# EAGLE schematic Resistor_Resistor (EAGLE 8.3.0), part 10 of 43
## Parts (continued)
R13078  10K  RESISTOR_0201  [0201]
R13079  10K  RESISTOR_0201  [0201]
R13080  10K  RESISTOR_0201  [0201]
R13081  10K  RESISTOR_0201  [0201]
R13082  10K  RESISTOR_0201  [0201]
R13083  10K  RESISTOR_0201  [0201]
R13084  10K  RESISTOR_0201  [0201]
R13085  10K  RESISTOR_0201  [0201]
R13086  10K  RESISTOR_0201  [0201]
R13087  10K  RESISTOR_0201  [0201]
R13088  10K  RESISTOR_0201  [0201]
R13089  10K  RESISTOR_0201  [0201]
R13090  10K  RESISTOR_0201  [0201]
R13091  10K  RESISTOR_0201  [0201]
R13092  10K  RESISTOR_0201  [0201]
R13093  10K  RESISTOR_0201  [0201]
R13094  10K  RESISTOR_0201  [0201]
R13095  10K  RESISTOR_0201  [0201]
R13096  10K  RESISTOR_0201  [0201]
R13097  10K  RESISTOR_0201  [0201]
R13098  10K  RESISTOR_0201  [0201]
R13099  10K  RESISTOR_0201  [0201]
R13100  10K  RESISTOR_0201  [0201]
R13101  10K  RESISTOR_0201  [0201]
R13102  10K  RESISTOR_0201  [0201]
R13103  10K  RESISTOR_0201  [0201]
R13104  10K  RESISTOR_0201  [0201]
R13105  10K  RESISTOR_0201  [0201]
R13106  10K  RESISTOR_0201  [0201]
R13107  10K  RESISTOR_0201  [0201]
R13108  10K  RESISTOR_0201  [0201]
R13109  10K  RESISTOR_0201  [0201]
R13110  10K  RESISTOR_0201  [0201]
R13111  10K  RESISTOR_0201  [0201]
R13112  10K  RESISTOR_0201  [0201]
R13113  10K  RESISTOR_0201  [0201]
R13114  10K  RESISTOR_0201  [0201]
R13115  10K  RESISTOR_0201  [0201]
R13116  10K  RESISTOR_0201  [0201]
R13117  10K  RESISTOR_0201  [0201]
R13118  10K  RESISTOR_0201  [0201]
R13119  10K  RESISTOR_0201  [0201]
R13120  10K  RESISTOR_0201  [0201]
R13121  10K  RESISTOR_0201  [0201]
R13122  10K  RESISTOR_0201  [0201]
R13123  10K  RESISTOR_0201  [0201]
R13124  10K  RESISTOR_0201  [0201]
R13125  10K  RESISTOR_0201  [0201]
R13126  10K  RESISTOR_0201  [0201]
R13127  10K  RESISTOR_0201  [0201]
R13128  10K  RESISTOR_0201  [0201]
R13129  10K  RESISTOR_0201  [0201]
R13130  10K  RESISTOR_0201  [0201]
R13131  10K  RESISTOR_0201  [0201]
R13132  10K  RESISTOR_0201  [0201]
R13133  10K  RESISTOR_0201  [0201]
R13134  10K  RESISTOR_0201  [0201]
R13135  10K  RESISTOR_0201  [0201]
R13136  10K  RESISTOR_0201  [0201]
R13137  10K  RESISTOR_0201  [0201]
R13138  10K  RESISTOR_0201  [0201]
R13139  10K  RESISTOR_0201  [0201]
R13140  10K  RESISTOR_0201  [0201]
R13141  10K  RESISTOR_0201  [0201]
R13142  10K  RESISTOR_0201  [0201]
R13143  10K  RESISTOR_0201  [0201]
R13144  10K  RESISTOR_0201  [0201]
R13145  10K  RESISTOR_0201  [0201]
R13146  10K  RESISTOR_0201  [0201]
R13147  10K  RESISTOR_0201  [0201]
R13148  10K  RESISTOR_0201  [0201]
R13149  10K  RESISTOR_0201  [0201]
R13150  10K  RESISTOR_0201  [0201]
R13151  10K  RESISTOR_0201  [0201]
R13152  10K  RESISTOR_0201  [0201]
R13153  10K  RESISTOR_0201  [0201]
R13154  10K  RESISTOR_0201  [0201]
R13155  10K  RESISTOR_0201  [0201]
R13156  10K  RESISTOR_0201  [0201]
R13157  10K  RESISTOR_0201  [0201]
R13158  10K  RESISTOR_0201  [0201]
R13159  10K  RESISTOR_0201  [0201]
R13160  10K  RESISTOR_0201  [0201]
R13161  10K  RESISTOR_0201  [0201]
R13162  10K  RESISTOR_0201  [0201]
R13163  10K  RESISTOR_0201  [0201]
R13164  10K  RESISTOR_0201  [0201]
R13165  10K  RESISTOR_0201  [0201]
R13166  10K  RESISTOR_0201  [0201]
R13167  10K  RESISTOR_0201  [0201]
R13168  10K  RESISTOR_0201  [0201]
R13169  10K  RESISTOR_0201  [0201]
R13170  10K  RESISTOR_0201  [0201]
R13171  10K  RESISTOR_0201  [0201]
R13172  10K  RESISTOR_0201  [0201]
R13173  10K  RESISTOR_0201  [0201]
R13174  10K  RESISTOR_0201  [0201]
R13175  10K  RESISTOR_0201  [0201]
R13176  10K  RESISTOR_0201  [0201]
R13177  10K  RESISTOR_0201  [0201]
R13178  10K  RESISTOR_0201  [0201]
R13179  10K  RESISTOR_0201  [0201]
R13180  10K  RESISTOR_0201  [0201]
R13181  10K  RESISTOR_0201  [0201]
R13182  10K  RESISTOR_0201  [0201]
R13183  10K  RESISTOR_0201  [0201]
R13184  10K  RESISTOR_0201  [0201]
R13185  10K  RESISTOR_0201  [0201]
R13186  10K  RESISTOR_0201  [0201]
R13187  10K  RESISTOR_0201  [0201]
R13188  10K  RESISTOR_0201  [0201]
R13189  10K  RESISTOR_0201  [0201]
R13190  10K  RESISTOR_0201  [0201]
R13191  10K  RESISTOR_0201  [0201]
R13192  10K  RESISTOR_0201  [0201]
R13193  10K  RESISTOR_0201  [0201]
R13194  10K  RESISTOR_0201  [0201]
R13195  10K  RESISTOR_0201  [0201]
R13196  10K  RESISTOR_0201  [0201]
R13197  10K  RESISTOR_0201  [0201]
R13198  10K  RESISTOR_0201  [0201]
R13199  10K  RESISTOR_0201  [0201]
R13200  10K  RESISTOR_0201  [0201]
R13201  10K  RESISTOR_0201  [0201]
R13202  10K  RESISTOR_0201  [0201]
R13203  10K  RESISTOR_0201  [0201]
R13204  10K  RESISTOR_0201  [0201]
R13205  10K  RESISTOR_0201  [0201]
R13206  10K  RESISTOR_0201  [0201]
R13207  10K  RESISTOR_0201  [0201]
R13208  10K  RESISTOR_0201  [0201]
R13209  10K  RESISTOR_0201  [0201]
R13210  10K  RESISTOR_0201  [0201]
R13211  10K  RESISTOR_0201  [0201]
R13212  10K  RESISTOR_0201  [0201]
R13213  10K  RESISTOR_0201  [0201]
R13214  10K  RESISTOR_0201  [0201]
R13215  10K  RESISTOR_0201  [0201]
R13216  10K  RESISTOR_0201  [0201]
R13217  10K  RESISTOR_0201  [0201]
R13218  10K  RESISTOR_0201  [0201]
R13219  10K  RESISTOR_0201  [0201]
R13220  10K  RESISTOR_0201  [0201]
R13221  10K  RESISTOR_0201  [0201]
R13222  10K  RESISTOR_0201  [0201]
R13223  10K  RESISTOR_0201  [0201]
R13224  10K  RESISTOR_0201  [0201]
R13225  10K  RESISTOR_0201  [0201]
R13226  10K  RESISTOR_0201  [0201]
R13227  10K  RESISTOR_0201  [0201]
R13228  10K  RESISTOR_0201  [0201]
R13229  10K  RESISTOR_0201  [0201]
R13230  10K  RESISTOR_0201  [0201]
R13231  10K  RESISTOR_0201  [0201]
R13232  10K  RESISTOR_0201  [0201]
R13233  10K  RESISTOR_0201  [0201]
R13234  10K  RESISTOR_0201  [0201]
R13235  10K  RESISTOR_0201  [0201]
R13236  10K  RESISTOR_0201  [0201]
R13237  10K  RESISTOR_0201  [0201]
R13238  10K  RESISTOR_0201  [0201]
R13239  10K  RESISTOR_0201  [0201]
R13240  10K  RESISTOR_0201  [0201]
R13241  10K  RESISTOR_0201  [0201]
R13242  10K  RESISTOR_0201  [0201]
R13243  10K  RESISTOR_0201  [0201]
R13244  10K  RESISTOR_0201  [0201]
R13245  10K  RESISTOR_0201  [0201]
R13246  10K  RESISTOR_0201  [0201]
R13247  10K  RESISTOR_0201  [0201]
R13248  10K  RESISTOR_0201  [0201]
R13249  10K  RESISTOR_0201  [0201]
R13250  10K  RESISTOR_0201  [0201]
R13251  10K  RESISTOR_0201  [0201]
R13252  10K  RESISTOR_0201  [0201]
R13253  10K  RESISTOR_0201  [0201]
R13254  10K  RESISTOR_0201  [0201]
R13255  10K  RESISTOR_0201  [0201]
R13256  10K  RESISTOR_0201  [0201]
R13257  10K  RESISTOR_0201  [0201]
R13258  10K  RESISTOR_0201  [0201]
R13259  10K  RESISTOR_0201  [0201]
R13260  10K  RESISTOR_0201  [0201]
R13261  10K  RESISTOR_0201  [0201]
R13262  10K  RESISTOR_0201  [0201]
R13263  10K  RESISTOR_0201  [0201]
R13264  10K  RESISTOR_0201  [0201]
R13265  10K  RESISTOR_0201  [0201]
R13266  10K  RESISTOR_0201  [0201]
R13267  10K  RESISTOR_0201  [0201]
R13268  10K  RESISTOR_0201  [0201]
R13269  10K  RESISTOR_0201  [0201]
R13270  10K  RESISTOR_0201  [0201]
R13271  10K  RESISTOR_0201  [0201]
R13272  10K  RESISTOR_0201  [0201]
R13273  10K  RESISTOR_0201  [0201]
R13274  10K  RESISTOR_0201  [0201]
R13275  10K  RESISTOR_0201  [0201]
R13276  10K  RESISTOR_0201  [0201]
R13277  10K  RESISTOR_0201  [0201]
R13278  10K  RESISTOR_0201  [0201]
R13279  10K  RESISTOR_0201  [0201]
R13280  10K  RESISTOR_0201  [0201]
R13281  10K  RESISTOR_0201  [0201]
R13282  10K  RESISTOR_0201  [0201]
R13283  10K  RESISTOR_0201  [0201]
R13284  10K  RESISTOR_0201  [0201]
R13285  10K  RESISTOR_0201  [0201]
R13286  10K  RESISTOR_0201  [0201]
R13287  10K  RESISTOR_0201  [0201]
R13288  10K  RESISTOR_0201  [0201]
R13289  10K  RESISTOR_0201  [0201]
R13290  10K  RESISTOR_0201  [0201]
R13291  10K  RESISTOR_0201  [0201]
R13292  10K  RESISTOR_0201  [0201]
R13293  10K  RESISTOR_0201  [0201]
R13294  10K  RESISTOR_0201  [0201]
R13295  10K  RESISTOR_0201  [0201]
R13296  10K  RESISTOR_0201  [0201]
R13297  10K  RESISTOR_0201  [0201]
R13298  10K  RESISTOR_0201  [0201]
R13299  10K  RESISTOR_0201  [0201]
R13300  10K  RESISTOR_0201  [0201]
R13301  10K  RESISTOR_0201  [0201]
R13302  10K  RESISTOR_0201  [0201]
R13303  10K  RESISTOR_0201  [0201]
R13304  10K  RESISTOR_0201  [0201]
R13305  10K  RESISTOR_0201  [0201]
R13306  10K  RESISTOR_0201  [0201]
R13307  10K  RESISTOR_0201  [0201]
R13308  10K  RESISTOR_0201  [0201]
R13309  10K  RESISTOR_0201  [0201]
R13310  10K  RESISTOR_0201  [0201]
R13311  10K  RESISTOR_0201  [0201]
R13312  10K  RESISTOR_0201  [0201]
R13313  10K  RESISTOR_0201  [0201]
R13314  10K  RESISTOR_0201  [0201]
R13315  10K  RESISTOR_0201  [0201]
R13316  10K  RESISTOR_0201  [0201]
R13317  10K  RESISTOR_0201  [0201]
R13318  10K  RESISTOR_0201  [0201]
R13319  10K  RESISTOR_0201  [0201]
R13320  10K  RESISTOR_0201  [0201]
R13321  10K  RESISTOR_0201  [0201]
R13322  10K  RESISTOR_0201  [0201]
R13323  10K  RESISTOR_0201  [0201]
R13324  10K  RESISTOR_0201  [0201]
R13325  10K  RESISTOR_0201  [0201]
R13326  10K  RESISTOR_0201  [0201]
R13327  10K  RESISTOR_0201  [0201]
R13328  10K  RESISTOR_0201  [0201]
R13329  10K  RESISTOR_0201  [0201]
R13330  10K  RESISTOR_0201  [0201]
R13331  10K  RESISTOR_0201  [0201]
R13332  10K  RESISTOR_0201  [0201]
R13333  10K  RESISTOR_0201  [0201]
R13334  10K  RESISTOR_0201  [0201]
R13335  10K  RESISTOR_0201  [0201]
R13336  10K  RESISTOR_0201  [0201]
R13337  10K  RESISTOR_0201  [0201]
R13338  10K  RESISTOR_0201  [0201]
R13339  10K  RESISTOR_0201  [0201]
R13340  10K  RESISTOR_0201  [0201]
R13341  10K  RESISTOR_0201  [0201]
R13342  10K  RESISTOR_0201  [0201]
R13343  10K  RESISTOR_0201  [0201]
R13344  10K  RESISTOR_0201  [0201]
R13345  10K  RESISTOR_0201  [0201]
R13346  10K  RESISTOR_0201  [0201]
R13347  10K  RESISTOR_0201  [0201]
R13348  10K  RESISTOR_0201  [0201]
R13349  10K  RESISTOR_0201  [0201]
R13350  10K  RESISTOR_0201  [0201]
R13351  10K  RESISTOR_0201  [0201]
R13352  10K  RESISTOR_0201  [0201]
R13353  10K  RESISTOR_0201  [0201]
R13354  10K  RESISTOR_0201  [0201]
R13355  10K  RESISTOR_0201  [0201]
R13356  10K  RESISTOR_0201  [0201]
R13357  10K  RESISTOR_0201  [0201]
R13358  10K  RESISTOR_0201  [0201]
R13359  10K  RESISTOR_0201  [0201]
R13360  10K  RESISTOR_0201  [0201]
R13361  10K  RESISTOR_0201  [0201]
R13362  10K  RESISTOR_0201  [0201]
R13363  10K  RESISTOR_0201  [0201]
R13364  10K  RESISTOR_0201  [0201]
R13365  10K  RESISTOR_0201  [0201]
R13366  10K  RESISTOR_0201  [0201]
R13367  10K  RESISTOR_0201  [0201]
R13368  10K  RESISTOR_0201  [0201]
R13369  10K  RESISTOR_0201  [0201]
R13370  10K  RESISTOR_0201  [0201]
R13371  10K  RESISTOR_0201  [0201]
R13372  10K  RESISTOR_0201  [0201]
R13373  10K  RESISTOR_0201  [0201]
R13374  10K  RESISTOR_0201  [0201]
R13375  10K  RESISTOR_0201  [0201]
R13376  10K  RESISTOR_0201  [0201]
R13377  10K  RESISTOR_0201  [0201]
R13378  10K  RESISTOR_0201  [0201]
R13379  10K  RESISTOR_0201  [0201]
R13380  10K  RESISTOR_0201  [0201]
R13381  10K  RESISTOR_0201  [0201]
R13382  10K  RESISTOR_0201  [0201]
R13383  10K  RESISTOR_0201  [0201]
R13384  10K  RESISTOR_0201  [0201]
R13385  10K  RESISTOR_0201  [0201]
R13386  10K  RESISTOR_0201  [0201]
R13387  10K  RESISTOR_0201  [0201]
R13388  10K  RESISTOR_0201  [0201]
R13389  10K  RESISTOR_0201  [0201]
R13390  10K  RESISTOR_0201  [0201]
R13391  10K  RESISTOR_0201  [0201]
R13392  10K  RESISTOR_0201  [0201]
R13393  10K  RESISTOR_0201  [0201]
R13394  10K  RESISTOR_0201  [0201]
R13395  10K  RESISTOR_0201  [0201]
R13396  10K  RESISTOR_0201  [0201]
R13397  10K  RESISTOR_0201  [0201]
R13398  10K  RESISTOR_0201  [0201]
R13399  10K  RESISTOR_0201  [0201]
R13400  10K  RESISTOR_0201  [0201]
R13401  10K  RESISTOR_0201  [0201]
R13402  10K  RESISTOR_0201  [0201]
R13403  10K  RESISTOR_0201  [0201]
R13404  10K  RESISTOR_0201  [0201]
R13405  10K  RESISTOR_0201  [0201]
R13406  10K  RESISTOR_0201  [0201]
R13407  10K  RESISTOR_0201  [0201]
R13408  10K  RESISTOR_0201  [0201]
R13409  10K  RESISTOR_0201  [0201]
R13410  10K  RESISTOR_0201  [0201]
R13411  10K  RESISTOR_0201  [0201]
R13412  10K  RESISTOR_0201  [0201]
R13413  10K  RESISTOR_0201  [0201]
R13414  10K  RESISTOR_0201  [0201]
R13415  10K  RESISTOR_0201  [0201]
R13416  10K  RESISTOR_0201  [0201]
R13417  10K  RESISTOR_0201  [0201]
R13418  10K  RESISTOR_0201  [0201]
R13419  10K  RESISTOR_0201  [0201]
R13420  10K  RESISTOR_0201  [0201]
R13421  10K  RESISTOR_0201  [0201]
R13422  10K  RESISTOR_0201  [0201]
R13423  10K  RESISTOR_0201  [0201]
R13424  10K  RESISTOR_0201  [0201]
R13425  10K  RESISTOR_0201  [0201]
R13426  10K  RESISTOR_0201  [0201]
R13427  10K  RESISTOR_0201  [0201]
R13428  10K  RESISTOR_0201  [0201]
R13429  10K  RESISTOR_0201  [0201]
R13430  10K  RESISTOR_0201  [0201]
R13431  10K  RESISTOR_0201  [0201]
R13432  10K  RESISTOR_0201  [0201]
R13433  10K  RESISTOR_0201  [0201]
R13434  10K  RESISTOR_0201  [0201]
R13435  10K  RESISTOR_0201  [0201]
R13436  10K  RESISTOR_0201  [0201]
R13437  10K  RESISTOR_0201  [0201]
R13438  10K  RESISTOR_0201  [0201]
R13439  10K  RESISTOR_0201  [0201]
R13440  10K  RESISTOR_0201  [0201]
R13441  10K  RESISTOR_0201  [0201]
R13442  10K  RESISTOR_0201  [0201]
R13443  10K  RESISTOR_0201  [0201]
R13444  10K  RESISTOR_0201  [0201]
R13445  10K  RESISTOR_0201  [0201]
R13446  10K  RESISTOR_0201  [0201]
R13447  10K  RESISTOR_0201  [0201]
R13448  10K  RESISTOR_0201  [0201]
R13449  10K  RESISTOR_0201  [0201]
R13450  10K  RESISTOR_0201  [0201]
R13451  10K  RESISTOR_0201  [0201]
R13452  10K  RESISTOR_0201  [0201]
R13453  10K  RESISTOR_0201  [0201]
R13454  10K  RESISTOR_0201  [0201]
R13455  10K  RESISTOR_0201  [0201]
R13456  10K  RESISTOR_0201  [0201]
R13457  10K  RESISTOR_0201  [0201]
R13458  10K  RESISTOR_0201  [0201]
R13459  10K  RESISTOR_0201  [0201]
R13460  10K  RESISTOR_0201  [0201]
R13461  10K  RESISTOR_0201  [0201]
R13462  10K  RESISTOR_0201  [0201]
R13463  10K  RESISTOR_0201  [0201]
R13464  10K  RESISTOR_0201  [0201]
R13465  10K  RESISTOR_0201  [0201]
R13466  10K  RESISTOR_0201  [0201]
R13467  10K  RESISTOR_0201  [0201]
R13468  10K  RESISTOR_0201  [0201]
R13469  10K  RESISTOR_0201  [0201]
R13470  10K  RESISTOR_0201  [0201]
R13471  10K  RESISTOR_0201  [0201]
R13472  10K  RESISTOR_0201  [0201]
R13473  10K  RESISTOR_0201  [0201]
R13474  10K  RESISTOR_0201  [0201]
R13475  10K  RESISTOR_0201  [0201]
R13476  10K  RESISTOR_0201  [0201]
R13477  10K  RESISTOR_0201  [0201]
R13478  10K  RESISTOR_0201  [0201]
R13479  10K  RESISTOR_0201  [0201]
R13480  10K  RESISTOR_0201  [0201]
R13481  10K  RESISTOR_0201  [0201]
R13482  10K  RESISTOR_0201  [0201]
R13483  10K  RESISTOR_0201  [0201]
R13484  10K  RESISTOR_0201  [0201]
R13485  10K  RESISTOR_0201  [0201]
R13486  10K  RESISTOR_0201  [0201]
R13487  10K  RESISTOR_0201  [0201]
R13488  10K  RESISTOR_0201  [0201]
R13489  10K  RESISTOR_0201  [0201]
R13490  10K  RESISTOR_0201  [0201]
R13491  10K  RESISTOR_0201  [0201]
R13492  10K  RESISTOR_0201  [0201]
R13493  10K  RESISTOR_0201  [0201]
R13494  10K  RESISTOR_0201  [0201]
R13495  10K  RESISTOR_0201  [0201]
R13496  10K  RESISTOR_0201  [0201]
R13497  10K  RESISTOR_0201  [0201]
R13498  10K  RESISTOR_0201  [0201]
R13499  10K  RESISTOR_0201  [0201]
R13500  10K  RESISTOR_0201  [0201]
R13501  10K  RESISTOR_0201  [0201]
R13502  10K  RESISTOR_0201  [0201]
R13503  10K  RESISTOR_0201  [0201]
R13504  10K  RESISTOR_0201  [0201]
R13505  10K  RESISTOR_0201  [0201]
R13506  10K  RESISTOR_0201  [0201]
R13507  10K  RESISTOR_0201  [0201]
R13508  10K  RESISTOR_0201  [0201]
R13509  10K  RESISTOR_0201  [0201]
R13510  10K  RESISTOR_0201  [0201]
R13511  10K  RESISTOR_0201  [0201]
R13512  10K  RESISTOR_0201  [0201]
R13513  10K  RESISTOR_0201  [0201]
R13514  10K  RESISTOR_0201  [0201]
R13515  10K  RESISTOR_0201  [0201]
R13516  10K  RESISTOR_0201  [0201]
R13517  10K  RESISTOR_0201  [0201]
R13518  10K  RESISTOR_0201  [0201]
R13519  10K  RESISTOR_0201  [0201]
R13520  10K  RESISTOR_0201  [0201]
R13521  10K  RESISTOR_0201  [0201]
R13522  10K  RESISTOR_0201  [0201]
R13523  10K  RESISTOR_0201  [0201]
R13524  10K  RESISTOR_0201  [0201]
R13525  10K  RESISTOR_0201  [0201]
R13526  10K  RESISTOR_0201  [0201]
R13527  10K  RESISTOR_0201  [0201]
R13528  10K  RESISTOR_0201  [0201]
R13529  10K  RESISTOR_0201  [0201]
R13530  10K  RESISTOR_0201  [0201]
R13531  10K  RESISTOR_0201  [0201]
R13532  10K  RESISTOR_0201  [0201]
R13533  10K  RESISTOR_0201  [0201]
R13534  10K  RESISTOR_0201  [0201]
R13535  10K  RESISTOR_0201  [0201]
R13536  10K  RESISTOR_0201  [0201]
R13537  10K  RESISTOR_0201  [0201]
R13538  10K  RESISTOR_0201  [0201]
R13539  10K  RESISTOR_0201  [0201]
R13540  10K  RESISTOR_0201  [0201]
R13541  10K  RESISTOR_0201  [0201]
R13542  10K  RESISTOR_0201  [0201]
R13543  10K  RESISTOR_0201  [0201]
R13544  10K  RESISTOR_0201  [0201]
R13545  10K  RESISTOR_0201  [0201]
R13546  10K  RESISTOR_0201  [0201]
R13547  10K  RESISTOR_0201  [0201]
R13548  10K  RESISTOR_0201  [0201]
R13549  10K  RESISTOR_0201  [0201]
R13550  10K  RESISTOR_0201  [0201]
R13551  10K  RESISTOR_0201  [0201]
R13552  10K  RESISTOR_0201  [0201]
R13553  10K  RESISTOR_0201  [0201]
R13554  10K  RESISTOR_0201  [0201]
R13555  10K  RESISTOR_0201  [0201]
R13556  10K  RESISTOR_0201  [0201]
R13557  10K  RESISTOR_0201  [0201]
R13558  10K  RESISTOR_0201  [0201]
R13559  10K  RESISTOR_0201  [0201]
R13560  10K  RESISTOR_0201  [0201]
R13561  10K  RESISTOR_0201  [0201]
R13562  10K  RESISTOR_0201  [0201]
R13563  10K  RESISTOR_0201  [0201]
R13564  10K  RESISTOR_0201  [0201]
R13565  10K  RESISTOR_0201  [0201]
R13566  10K  RESISTOR_0201  [0201]
R13567  10K  RESISTOR_0201  [0201]
R13568  10K  RESISTOR_0201  [0201]
R13569  10K  RESISTOR_0201  [0201]
R13570  10K  RESISTOR_0201  [0201]
R13571  10K  RESISTOR_0201  [0201]
R13572  10K  RESISTOR_0201  [0201]
R13573  10K  RESISTOR_0201  [0201]
R13574  10K  RESISTOR_0201  [0201]
R13575  10K  RESISTOR_0201  [0201]
R13576  10K  RESISTOR_0201  [0201]
R13577  10K  RESISTOR_0201  [0201]
R13578  10K  RESISTOR_0201  [0201]
R13579  10K  RESISTOR_0201  [0201]
R13580  10K  RESISTOR_0201  [0201]
R13581  10K  RESISTOR_0201  [0201]
R13582  10K  RESISTOR_0201  [0201]
R13583  10K  RESISTOR_0201  [0201]
R13584  10K  RESISTOR_0201  [0201]
R13585  10K  RESISTOR_0201  [0201]
R13586  10K  RESISTOR_0201  [0201]
R13587  10K  RESISTOR_0201  [0201]
R13588  10K  RESISTOR_0201  [0201]
R13589  10K  RESISTOR_0201  [0201]
R13590  10K  RESISTOR_0201  [0201]
R13591  10K  RESISTOR_0201  [0201]
R13592  10K  RESISTOR_0201  [0201]
R13593  10K  RESISTOR_0201  [0201]
R13594  10K  RESISTOR_0201  [0201]
R13595  10K  RESISTOR_0201  [0201]
R13596  10K  RESISTOR_0201  [0201]
R13597  10K  RESISTOR_0201  [0201]
R13598  10K  RESISTOR_0201  [0201]
R13599  10K  RESISTOR_0201  [0201]
R13600  10K  RESISTOR_0201  [0201]
R13601  10K  RESISTOR_0201  [0201]
R13602  10K  RESISTOR_0201  [0201]
R13603  10K  RESISTOR_0201  [0201]
R13604  10K  RESISTOR_0201  [0201]
R13605  10K  RESISTOR_0201  [0201]
R13606  10K  RESISTOR_0201  [0201]
R13607  10K  RESISTOR_0201  [0201]
R13608  10K  RESISTOR_0201  [0201]
R13609  10K  RESISTOR_0201  [0201]
R13610  10K  RESISTOR_0201  [0201]
R13611  10K  RESISTOR_0201  [0201]
R13612  10K  RESISTOR_0201  [0201]
R13613  10K  RESISTOR_0201  [0201]
R13614  10K  RESISTOR_0201  [0201]
R13615  10K  RESISTOR_0201  [0201]
R13616  10K  RESISTOR_0201  [0201]
R13617  10K  RESISTOR_0201  [0201]
R13618  10K  RESISTOR_0201  [0201]
R13619  10K  RESISTOR_0201  [0201]
R13620  10K  RESISTOR_0201  [0201]
R13621  10K  RESISTOR_0201  [0201]
R13622  10K  RESISTOR_0201  [0201]
R13623  10K  RESISTOR_0201  [0201]
R13624  10K  RESISTOR_0201  [0201]
R13625  10K  RESISTOR_0201  [0201]
R13626  10K  RESISTOR_0201  [0201]
R13627  10K  RESISTOR_0201  [0201]
R13628  10K  RESISTOR_0201  [0201]
R13629  10K  RESISTOR_0201  [0201]
R13630  10K  RESISTOR_0201  [0201]
R13631  10K  RESISTOR_0201  [0201]
R13632  10K  RESISTOR_0201  [0201]
R13633  10K  RESISTOR_0201  [0201]
R13634  10K  RESISTOR_0201  [0201]
R13635  10K  RESISTOR_0201  [0201]
R13636  10K  RESISTOR_0201  [0201]
R13637  10K  RESISTOR_0201  [0201]
R13638  10K  RESISTOR_0201  [0201]
R13639  10K  RESISTOR_0201  [0201]
R13640  10K  RESISTOR_0201  [0201]
R13641  10K  RESISTOR_0201  [0201]
R13642  10K  RESISTOR_0201  [0201]
R13643  10K  RESISTOR_0201  [0201]
R13644  10K  RESISTOR_0201  [0201]
R13645  10K  RESISTOR_0201  [0201]
R13646  10K  RESISTOR_0201  [0201]
R13647  10K  RESISTOR_0201  [0201]
R13648  10K  RESISTOR_0201  [0201]
R13649  10K  RESISTOR_0201  [0201]
R13650  10K  RESISTOR_0201  [0201]
R13651  10K  RESISTOR_0201  [0201]
R13652  10K  RESISTOR_0201  [0201]
R13653  10K  RESISTOR_0201  [0201]
R13654  10K  RESISTOR_0201  [0201]
R13655  10K  RESISTOR_0201  [0201]
R13656  10K  RESISTOR_0201  [0201]
R13657  10K  RESISTOR_0201  [0201]
R13658  10K  RESISTOR_0201  [0201]
R13659  10K  RESISTOR_0201  [0201]
R13660  10K  RESISTOR_0201  [0201]
R13661  10K  RESISTOR_0201  [0201]
R13662  10K  RESISTOR_0201  [0201]
R13663  10K  RESISTOR_0201  [0201]
R13664  10K  RESISTOR_0201  [0201]
R13665  10K  RESISTOR_0201  [0201]
R13666  10K  RESISTOR_0201  [0201]
R13667  10K  RESISTOR_0201  [0201]
R13668  10K  RESISTOR_0201  [0201]
R13669  10K  RESISTOR_0201  [0201]
R13670  10K  RESISTOR_0201  [0201]
R13671  10K  RESISTOR_0201  [0201]
R13672  10K  RESISTOR_0201  [0201]
R13673  10K  RESISTOR_0201  [0201]
R13674  10K  RESISTOR_0201  [0201]
R13675  10K  RESISTOR_0201  [0201]
R13676  10K  RESISTOR_0201  [0201]
R13677  10K  RESISTOR_0201  [0201]
R13678  10K  RESISTOR_0201  [0201]
R13679  10K  RESISTOR_0201  [0201]
R13680  10K  RESISTOR_0201  [0201]
R13681  10K  RESISTOR_0201  [0201]
R13682  10K  RESISTOR_0201  [0201]
R13683  10K  RESISTOR_0201  [0201]
R13684  10K  RESISTOR_0201  [0201]
R13685  10K  RESISTOR_0201  [0201]
R13686  10K  RESISTOR_0201  [0201]
R13687  10K  RESISTOR_0201  [0201]
R13688  10K  RESISTOR_0201  [0201]
R13689  10K  RESISTOR_0201  [0201]
R13690  10K  RESISTOR_0201  [0201]
R13691  10K  RESISTOR_0201  [0201]
R13692  10K  RESISTOR_0201  [0201]
R13693  10K  RESISTOR_0201  [0201]
R13694  10K  RESISTOR_0201  [0201]
R13695  10K  RESISTOR_0201  [0201]
R13696  10K  RESISTOR_0201  [0201]
R13697  10K  RESISTOR_0201  [0201]
R13698  10K  RESISTOR_0201  [0201]
R13699  10K  RESISTOR_0201  [0201]
R13700  10K  RESISTOR_0201  [0201]
R13701  10K  RESISTOR_0201  [0201]
R13702  10K  RESISTOR_0201  [0201]
R13703  10K  RESISTOR_0201  [0201]
R13704  10K  RESISTOR_0201  [0201]
R13705  10K  RESISTOR_0201  [0201]
R13706  10K  RESISTOR_0201  [0201]
R13707  10K  RESISTOR_0201  [0201]
R13708  10K  RESISTOR_0201  [0201]
R13709  10K  RESISTOR_0201  [0201]
R13710  10K  RESISTOR_0201  [0201]
R13711  10K  RESISTOR_0201  [0201]
R13712  10K  RESISTOR_0201  [0201]
R13713  10K  RESISTOR_0201  [0201]
R13714  10K  RESISTOR_0201  [0201]
R13715  10K  RESISTOR_0201  [0201]
R13716  10K  RESISTOR_0201  [0201]
R13717  10K  RESISTOR_0201  [0201]
R13718  10K  RESISTOR_0201  [0201]
R13719  10K  RESISTOR_0201  [0201]
R13720  10K  RESISTOR_0201  [0201]
R13721  10K  RESISTOR_0201  [0201]
R13722  10K  RESISTOR_0201  [0201]
R13723  10K  RESISTOR_0201  [0201]
R13724  10K  RESISTOR_0201  [0201]
R13725  10K  RESISTOR_0201  [0201]
R13726  10K  RESISTOR_0201  [0201]
R13727  10K  RESISTOR_0201  [0201]
R13728  10K  RESISTOR_0201  [0201]
R13729  10K  RESISTOR_0201  [0201]
R13730  10K  RESISTOR_0201  [0201]
R13731  10K  RESISTOR_0201  [0201]
R13732  10K  RESISTOR_0201  [0201]
R13733  10K  RESISTOR_0201  [0201]
R13734  10K  RESISTOR_0201  [0201]
R13735  10K  RESISTOR_0201  [0201]
R13736  10K  RESISTOR_0201  [0201]
R13737  10K  RESISTOR_0201  [0201]
R13738  10K  RESISTOR_0201  [0201]
R13739  10K  RESISTOR_0201  [0201]
R13740  10K  RESISTOR_0201  [0201]
R13741  10K  RESISTOR_0201  [0201]
R13742  10K  RESISTOR_0201  [0201]
R13743  10K  RESISTOR_0201  [0201]
R13744  10K  RESISTOR_0201  [0201]
R13745  10K  RESISTOR_0201  [0201]
R13746  10K  RESISTOR_0201  [0201]
R13747  10K  RESISTOR_0201  [0201]
R13748  10K  RESISTOR_0201  [0201]
R13749  10K  RESISTOR_0201  [0201]
R13750  10K  RESISTOR_0201  [0201]
R13751  10K  RESISTOR_0201  [0201]
R13752  10K  RESISTOR_0201  [0201]
R13753  10K  RESISTOR_0201  [0201]
R13754  10K  RESISTOR_0201  [0201]
R13755  10K  RESISTOR_0201  [0201]
R13756  10K  RESISTOR_0201  [0201]
R13757  10K  RESISTOR_0201  [0201]
R13758  10K  RESISTOR_0201  [0201]
R13759  10K  RESISTOR_0201  [0201]
R13760  10K  RESISTOR_0201  [0201]
R13761  10K  RESISTOR_0201  [0201]
R13762  10K  RESISTOR_0201  [0201]
R13763  10K  RESISTOR_0201  [0201]
R13764  10K  RESISTOR_0201  [0201]
R13765  10K  RESISTOR_0201  [0201]
R13766  10K  RESISTOR_0201  [0201]
R13767  10K  RESISTOR_0201  [0201]
R13768  10K  RESISTOR_0201  [0201]
R13769  10K  RESISTOR_0201  [0201]
R13770  10K  RESISTOR_0201  [0201]
R13771  10K  RESISTOR_0201  [0201]
R13772  10K  RESISTOR_0201  [0201]
R13773  10K  RESISTOR_0201  [0201]
R13774  10K  RESISTOR_0201  [0201]
R13775  10K  RESISTOR_0201  [0201]
R13776  10K  RESISTOR_0201  [0201]
R13777  10K  RESISTOR_0201  [0201]
R13778  10K  RESISTOR_0201  [0201]
R13779  10K  RESISTOR_0201  [0201]
R13780  10K  RESISTOR_0201  [0201]
R13781  10K  RESISTOR_0201  [0201]
R13782  10K  RESISTOR_0201  [0201]
R13783  10K  RESISTOR_0201  [0201]
R13784  10K  RESISTOR_0201  [0201]
R13785  10K  RESISTOR_0201  [0201]
R13786  10K  RESISTOR_0201  [0201]
R13787  10K  RESISTOR_0201  [0201]
R13788  10K  RESISTOR_0201  [0201]
R13789  10K  RESISTOR_0201  [0201]
R13790  10K  RESISTOR_0201  [0201]
R13791  10K  RESISTOR_0201  [0201]
R13792  10K  RESISTOR_0201  [0201]
R13793  10K  RESISTOR_0201  [0201]
R13794  10K  RESISTOR_0201  [0201]
R13795  10K  RESISTOR_0201  [0201]
R13796  10K  RESISTOR_0201  [0201]
R13797  10K  RESISTOR_0201  [0201]
R13798  10K  RESISTOR_0201  [0201]
R13799  10K  RESISTOR_0201  [0201]
R13800  10K  RESISTOR_0201  [0201]
R13801  10K  RESISTOR_0201  [0201]
R13802  10K  RESISTOR_0201  [0201]
R13803  10K  RESISTOR_0201  [0201]
R13804  10K  RESISTOR_0201  [0201]
R13805  10K  RESISTOR_0201  [0201]
R13806  10K  RESISTOR_0201  [0201]
R13807  10K  RESISTOR_0201  [0201]
R13808  10K  RESISTOR_0201  [0201]
R13809  10K  RESISTOR_0201  [0201]
R13810  10K  RESISTOR_0201  [0201]
R13811  10K  RESISTOR_0201  [0201]
R13812  10K  RESISTOR_0201  [0201]
R13813  10K  RESISTOR_0201  [0201]
R13814  10K  RESISTOR_0201  [0201]
R13815  10K  RESISTOR_0201  [0201]
R13816  10K  RESISTOR_0201  [0201]
R13817  10K  RESISTOR_0201  [0201]
R13818  10K  RESISTOR_0201  [0201]
R13819  10K  RESISTOR_0201  [0201]
R13820  10K  RESISTOR_0201  [0201]
R13821  10K  RESISTOR_0201  [0201]
R13822  10K  RESISTOR_0201  [0201]
R13823  10K  RESISTOR_0201  [0201]
R13824  10K  RESISTOR_0201  [0201]
R13825  10K  RESISTOR_0201  [0201]
R13826  10K  RESISTOR_0201  [0201]
R13827  10K  RESISTOR_0201  [0201]
R13828  10K  RESISTOR_0201  [0201]
R13829  10K  RESISTOR_0201  [0201]
R13830  10K  RESISTOR_0201  [0201]
R13831  10K  RESISTOR_0201  [0201]
R13832  10K  RESISTOR_0201  [0201]
R13833  10K  RESISTOR_0201  [0201]
R13834  10K  RESISTOR_0201  [0201]
R13835  10K  RESISTOR_0201  [0201]
R13836  10K  RESISTOR_0201  [0201]
R13837  10K  RESISTOR_0201  [0201]
R13838  10K  RESISTOR_0201  [0201]
R13839  10K  RESISTOR_0201  [0201]
R13840  10K  RESISTOR_0201  [0201]
R13841  10K  RESISTOR_0201  [0201]
R13842  10K  RESISTOR_0201  [0201]
R13843  10K  RESISTOR_0201  [0201]
R13844  10K  RESISTOR_0201  [0201]
R13845  10K  RESISTOR_0201  [0201]
R13846  10K  RESISTOR_0201  [0201]
R13847  10K  RESISTOR_0201  [0201]
R13848  10K  RESISTOR_0201  [0201]
R13849  10K  RESISTOR_0201  [0201]
R13850  10K  RESISTOR_0201  [0201]
R13851  10K  RESISTOR_0201  [0201]
R13852  10K  RESISTOR_0201  [0201]
R13853  10K  RESISTOR_0201  [0201]
R13854  10K  RESISTOR_0201  [0201]
R13855  10K  RESISTOR_0201  [0201]
R13856  10K  RESISTOR_0201  [0201]
R13857  10K  RESISTOR_0201  [0201]
R13858  10K  RESISTOR_0201  [0201]
R13859  10K  RESISTOR_0201  [0201]
R13860  10K  RESISTOR_0201  [0201]
R13861  10K  RESISTOR_0201  [0201]
R13862  10K  RESISTOR_0201  [0201]
R13863  10K  RESISTOR_0201  [0201]
R13864  10K  RESISTOR_0201  [0201]
R13865  10K  RESISTOR_0201  [0201]
R13866  10K  RESISTOR_0201  [0201]
R13867  10K  RESISTOR_0201  [0201]
R13868  10K  RESISTOR_0201  [0201]
R13869  10K  RESISTOR_0201  [0201]
R13870  10K  RESISTOR_0201  [0201]
R13871  10K  RESISTOR_0201  [0201]
R13872  10K  RESISTOR_0201  [0201]
R13873  10K  RESISTOR_0201  [0201]
R13874  10K  RESISTOR_0201  [0201]
R13875  10K  RESISTOR_0201  [0201]
R13876  10K  RESISTOR_0201  [0201]
R13877  10K  RESISTOR_0201  [0201]
R13878  10K  RESISTOR_0201  [0201]
R13879  10K  RESISTOR_0201  [0201]
R13880  10K  RESISTOR_0201  [0201]
R13881  10K  RESISTOR_0201  [0201]
R13882  10K  RESISTOR_0201  [0201]
R13883  10K  RESISTOR_0201  [0201]
R13884  10K  RESISTOR_0201  [0201]
R13885  10K  RESISTOR_0201  [0201]
R13886  10K  RESISTOR_0201  [0201]
R13887  10K  RESISTOR_0201  [0201]
R13888  10K  RESISTOR_0201  [0201]
R13889  10K  RESISTOR_0201  [0201]
R13890  10K  RESISTOR_0201  [0201]
R13891  10K  RESISTOR_0201  [0201]
R13892  10K  RESISTOR_0201  [0201]
R13893  10K  RESISTOR_0201  [0201]
R13894  10K  RESISTOR_0201  [0201]
R13895  10K  RESISTOR_0201  [0201]
R13896  10K  RESISTOR_0201  [0201]
R13897  10K  RESISTOR_0201  [0201]
R13898  10K  RESISTOR_0201  [0201]
R13899  10K  RESISTOR_0201  [0201]
R13900  10K  RESISTOR_0201  [0201]
R13901  10K  RESISTOR_0201  [0201]
R13902  10K  RESISTOR_0201  [0201]
R13903  10K  RESISTOR_0201  [0201]
R13904  10K  RESISTOR_0201  [0201]
R13905  10K  RESISTOR_0201  [0201]
R13906  10K  RESISTOR_0201  [0201]
R13907  10K  RESISTOR_0201  [0201]
R13908  10K  RESISTOR_0201  [0201]
R13909  10K  RESISTOR_0201  [0201]
R13910  10K  RESISTOR_0201  [0201]
R13911  10K  RESISTOR_0201  [0201]
R13912  10K  RESISTOR_0201  [0201]
R13913  10K  RESISTOR_0201  [0201]
R13914  10K  RESISTOR_0201  [0201]
R13915  10K  RESISTOR_0201  [0201]
R13916  10K  RESISTOR_0201  [0201]
R13917  10K  RESISTOR_0201  [0201]
R13918  10K  RESISTOR_0201  [0201]
R13919  10K  RESISTOR_0201  [0201]
R13920  10K  RESISTOR_0201  [0201]
R13921  10K  RESISTOR_0201  [0201]
R13922  10K  RESISTOR_0201  [0201]
R13923  10K  RESISTOR_0201  [0201]
R13924  10K  RESISTOR_0201  [0201]
R13925  10K  RESISTOR_0201  [0201]
R13926  10K  RESISTOR_0201  [0201]
R13927  10K  RESISTOR_0201  [0201]
R13928  10K  RESISTOR_0201  [0201]
R13929  10K  RESISTOR_0201  [0201]
R13930  10K  RESISTOR_0201  [0201]
R13931  10K  RESISTOR_0201  [0201]
R13932  10K  RESISTOR_0201  [0201]
R13933  10K  RESISTOR_0201  [0201]
R13934  10K  RESISTOR_0201  [0201]
R13935  10K  RESISTOR_0201  [0201]
R13936  10K  RESISTOR_0201  [0201]
R13937  10K  RESISTOR_0201  [0201]
R13938  10K  RESISTOR_0201  [0201]
R13939  10K  RESISTOR_0201  [0201]
R13940  10K  RESISTOR_0201  [0201]
R13941  10K  RESISTOR_0201  [0201]
R13942  10K  RESISTOR_0201  [0201]
R13943  10K  RESISTOR_0201  [0201]
R13944  10K  RESISTOR_0201  [0201]
R13945  10K  RESISTOR_0201  [0201]
R13946  10K  RESISTOR_0201  [0201]
R13947  10K  RESISTOR_0201  [0201]
R13948  10K  RESISTOR_0201  [0201]
R13949  10K  RESISTOR_0201  [0201]
R13950  10K  RESISTOR_0201  [0201]
R13951  10K  RESISTOR_0201  [0201]
R13952  10K  RESISTOR_0201  [0201]
R13953  10K  RESISTOR_0201  [0201]
R13954  10K  RESISTOR_0201  [0201]
R13955  10K  RESISTOR_0201  [0201]
R13956  10K  RESISTOR_0201  [0201]
R13957  10K  RESISTOR_0201  [0201]
R13958  10K  RESISTOR_0201  [0201]
R13959  10K  RESISTOR_0201  [0201]
R13960  10K  RESISTOR_0201  [0201]
R13961  10K  RESISTOR_0201  [0201]
R13962  10K  RESISTOR_0201  [0201]
R13963  10K  RESISTOR_0201  [0201]
R13964  10K  RESISTOR_0201  [0201]
R13965  10K  RESISTOR_0201  [0201]
R13966  10K  RESISTOR_0201  [0201]
R13967  10K  RESISTOR_0201  [0201]
R13968  10K  RESISTOR_0201  [0201]
R13969  10K  RESISTOR_0201  [0201]
R13970  10K  RESISTOR_0201  [0201]
R13971  10K  RESISTOR_0201  [0201]
R13972  10K  RESISTOR_0201  [0201]
R13973  10K  RESISTOR_0201  [0201]
R13974  10K  RESISTOR_0201  [0201]
R13975  10K  RESISTOR_0201  [0201]
R13976  10K  RESISTOR_0201  [0201]
R13977  10K  RESISTOR_0201  [0201]
R13978  10K  RESISTOR_0201  [0201]
R13979  10K  RESISTOR_0201  [0201]
R13980  10K  RESISTOR_0201  [0201]
R13981  10K  RESISTOR_0201  [0201]
R13982  10K  RESISTOR_0201  [0201]
R13983  10K  RESISTOR_0201  [0201]
R13984  10K  RESISTOR_0201  [0201]
R13985  10K  RESISTOR_0201  [0201]
R13986  10K  RESISTOR_0201  [0201]
R13987  10K  RESISTOR_0201  [0201]
R13988  10K  RESISTOR_0201  [0201]
R13989  10K  RESISTOR_0201  [0201]
R13990  10K  RESISTOR_0201  [0201]
R13991  10K  RESISTOR_0201  [0201]
R13992  10K  RESISTOR_0201  [0201]
R13993  10K  RESISTOR_0201  [0201]
R13994  10K  RESISTOR_0201  [0201]
R13995  10K  RESISTOR_0201  [0201]
R13996  10K  RESISTOR_0201  [0201]
R13997  10K  RESISTOR_0201  [0201]
R13998  10K  RESISTOR_0201  [0201]
R13999  10K  RESISTOR_0201  [0201]
R14000  10K  RESISTOR_0201  [0201]
R14001  10K  RESISTOR_0201  [0201]
R14002  10K  RESISTOR_0201  [0201]
R14003  10K  RESISTOR_0201  [0201]
R14004  10K  RESISTOR_0201  [0201]
R14005  10K  RESISTOR_0201  [0201]
R14006  10K  RESISTOR_0201  [0201]
R14007  10K  RESISTOR_0201  [0201]
R14008  10K  RESISTOR_0201  [0201]
R14009  10K  RESISTOR_0201  [0201]
R14010  10K  RESISTOR_0201  [0201]
R14011  10K  RESISTOR_0201  [0201]
R14012  10K  RESISTOR_0201  [0201]
R14013  10K  RESISTOR_0201  [0201]
R14014  10K  RESISTOR_0201  [0201]
R14015  10K  RESISTOR_0201  [0201]
R14016  10K  RESISTOR_0201  [0201]
R14017  10K  RESISTOR_0201  [0201]
R14018  10K  RESISTOR_0201  [0201]
R14019  10K  RESISTOR_0201  [0201]
R14020  10K  RESISTOR_0201  [0201]
R14021  10K  RESISTOR_0201  [0201]
R14022  10K  RESISTOR_0201  [0201]
R14023  10K  RESISTOR_0201  [0201]
R14024  10K  RESISTOR_0201  [0201]
R14025  10K  RESISTOR_0201  [0201]
R14026  10K  RESISTOR_0201  [0201]
R14027  10K  RESISTOR_0201  [0201]
R14028  10K  RESISTOR_0201  [0201]
R14029  10K  RESISTOR_0201  [0201]
R14030  10K  RESISTOR_0201  [0201]
R14031  10K  RESISTOR_0201  [0201]
R14032  10K  RESISTOR_0201  [0201]
R14033  10K  RESISTOR_0201  [0201]
R14034  10K  RESISTOR_0201  [0201]
R14035  10K  RESISTOR_0201  [0201]
R14036  10K  RESISTOR_0201  [0201]
R14037  10K  RESISTOR_0201  [0201]
R14038  10K  RESISTOR_0201  [0201]
R14039  10K  RESISTOR_0201  [0201]
R14040  10K  RESISTOR_0201  [0201]
R14041  10K  RESISTOR_0201  [0201]
R14042  10K  RESISTOR_0201  [0201]
R14043  10K  RESISTOR_0201  [0201]
R14044  10K  RESISTOR_0201  [0201]
R14045  10K  RESISTOR_0201  [0201]
R14046  10K  RESISTOR_0201  [0201]
R14047  10K  RESISTOR_0201  [0201]
R14048  10K  RESISTOR_0201  [0201]
R14049  10K  RESISTOR_0201  [0201]
R14050  10K  RESISTOR_0201  [0201]
R14051  10K  RESISTOR_0201  [0201]
R14052  10K  RESISTOR_0201  [0201]
R14053  10K  RESISTOR_0201  [0201]
R14054  10K  RESISTOR_0201  [0201]
R14055  10K  RESISTOR_0201  [0201]
R14056  10K  RESISTOR_0201  [0201]
R14057  10K  RESISTOR_0201  [0201]
R14058  10K  RESISTOR_0201  [0201]
R14059  10K  RESISTOR_0201  [0201]
R14060  10K  RESISTOR_0201  [0201]
R14061  10K  RESISTOR_0201  [0201]
R14062  10K  RESISTOR_0201  [0201]
R14063  10K  RESISTOR_0201  [0201]
R14064  10K  RESISTOR_0201  [0201]
R14065  10K  RESISTOR_0201  [0201]
R14066  10K  RESISTOR_0201  [0201]
R14067  10K  RESISTOR_0201  [0201]
R14068  10K  RESISTOR_0201  [0201]
R14069  10K  RESISTOR_0201  [0201]
R14070  10K  RESISTOR_0201  [0201]
R14071  10K  RESISTOR_0201  [0201]
R14072  10K  RESISTOR_0201  [0201]
R14073  10K  RESISTOR_0201  [0201]
R14074  10K  RESISTOR_0201  [0201]
R14075  10K  RESISTOR_0201  [0201]
R14076  10K  RESISTOR_0201  [0201]
R14077  10K  RESISTOR_0201  [0201]
R14078  10K  RESISTOR_0201  [0201]
R14079  10K  RESISTOR_0201  [0201]
R14080  10K  RESISTOR_0201  [0201]
R14081  10K  RESISTOR_0201  [0201]
R14082  10K  RESISTOR_0201  [0201]
R14083  10K  RESISTOR_0201  [0201]
R14084  10K  RESISTOR_0201  [0201]
R14085  10K  RESISTOR_0201  [0201]
R14086  10K  RESISTOR_0201  [0201]
R14087  10K  RESISTOR_0201  [0201]
R14088  10K  RESISTOR_0201  [0201]
R14089  10K  RESISTOR_0201  [0201]
R14090  10K  RESISTOR_0201  [0201]
R14091  10K  RESISTOR_0201  [0201]
R14092  10K  RESISTOR_0201  [0201]
R14093  10K  RESISTOR_0201  [0201]
R14094  10K  RESISTOR_0201  [0201]
R14095  10K  RESISTOR_0201  [0201]
R14096  10K  RESISTOR_0201  [0201]
R14097  10K  RESISTOR_0201  [0201]
R14098  10K  RESISTOR_0201  [0201]
R14099  10K  RESISTOR_0201  [0201]
R14100  10K  RESISTOR_0201  [0201]
R14101  10K  RESISTOR_0201  [0201]
R14102  10K  RESISTOR_0201  [0201]
R14103  10K  RESISTOR_0201  [0201]
R14104  10K  RESISTOR_0201  [0201]
R14105  10K  RESISTOR_0201  [0201]
R14106  10K  RESISTOR_0201  [0201]
R14107  10K  RESISTOR_0201  [0201]
R14108  10K  RESISTOR_0201  [0201]
R14109  10K  RESISTOR_0201  [0201]
R14110  10K  RESISTOR_0201  [0201]
R14111  10K  RESISTOR_0201  [0201]
R14112  10K  RESISTOR_0201  [0201]
R14113  10K  RESISTOR_0201  [0201]
R14114  10K  RESISTOR_0201  [0201]
R14115  10K  RESISTOR_0201  [0201]
R14116  10K  RESISTOR_0201  [0201]
R14117  10K  RESISTOR_0201  [0201]
R14118  10K  RESISTOR_0201  [0201]
R14119  10K  RESISTOR_0201  [0201]
R14120  10K  RESISTOR_0201  [0201]
R14121  10K  RESISTOR_0201  [0201]
R14122  10K  RESISTOR_0201  [0201]
R14123  10K  RESISTOR_0201  [0201]
R14124  10K  RESISTOR_0201  [0201]
R14125  10K  RESISTOR_0201  [0201]
R14126  10K  RESISTOR_0201  [0201]
R14127  10K  RESISTOR_0201  [0201]
R14128  10K  RESISTOR_0201  [0201]
R14129  10K  RESISTOR_0201  [0201]
R14130  10K  RESISTOR_0201  [0201]
R14131  10K  RESISTOR_0201  [0201]
R14132  10K  RESISTOR_0201  [0201]
R14133  10K  RESISTOR_0201  [0201]
R14134  10K  RESISTOR_0201  [0201]
R14135  10K  RESISTOR_0201  [0201]
R14136  10K  RESISTOR_0201  [0201]
R14137  10K  RESISTOR_0201  [0201]
R14138  10K  RESISTOR_0201  [0201]
R14139  10K  RESISTOR_0201  [0201]
R14140  10K  RESISTOR_0201  [0201]
R14141  10K  RESISTOR_0201  [0201]
R14142  10K  RESISTOR_0201  [0201]
R14143  10K  RESISTOR_0201  [0201]
R14144  10K  RESISTOR_0201  [0201]
R14145  10K  RESISTOR_0201  [0201]
R14146  10K  RESISTOR_0201  [0201]
R14147  10K  RESISTOR_0201  [0201]
R14148  10K  RESISTOR_0201  [0201]
R14149  10K  RESISTOR_0201  [0201]
R14150  10K  RESISTOR_0201  [0201]
R14151  10K  RESISTOR_0201  [0201]
R14152  10K  RESISTOR_0201  [0201]
R14153  10K  RESISTOR_0201  [0201]
R14154  10K  RESISTOR_0201  [0201]
R14155  10K  RESISTOR_0201  [0201]
R14156  10K  RESISTOR_0201  [0201]
R14157  10K  RESISTOR_0201  [0201]
R14158  10K  RESISTOR_0201  [0201]
R14159  10K  RESISTOR_0201  [0201]
R14160  10K  RESISTOR_0201  [0201]
R14161  10K  RESISTOR_0201  [0201]
R14162  10K  RESISTOR_0201  [0201]
R14163  10K  RESISTOR_0201  [0201]
R14164  10K  RESISTOR_0201  [0201]
R14165  10K  RESISTOR_0201  [0201]
R14166  10K  RESISTOR_0201  [0201]
R14167  10K  RESISTOR_0201  [0201]
R14168  10K  RESISTOR_0201  [0201]
R14169  10K  RESISTOR_0201  [0201]
R14170  10K  RESISTOR_0201  [0201]
R14171  10K  RESISTOR_0201  [0201]
R14172  10K  RESISTOR_0201  [0201]
R14173  10K  RESISTOR_0201  [0201]
R14174  10K  RESISTOR_0201  [0201]
R14175  10K  RESISTOR_0201  [0201]
R14176  10K  RESISTOR_0201  [0201]
R14177  10K  RESISTOR_0201  [0201]
R14178  10K  RESISTOR_0201  [0201]
R14179  10K  RESISTOR_0201  [0201]
R14180  10K  RESISTOR_0201  [0201]
R14181  10K  RESISTOR_0201  [0201]
R14182  10K  RESISTOR_0201  [0201]
R14183  10K  RESISTOR_0201  [0201]
R14184  10K  RESISTOR_0201  [0201]
R14185  10K  RESISTOR_0201  [0201]
R14186  10K  RESISTOR_0201  [0201]
R14187  10K  RESISTOR_0201  [0201]
R14188  10K  RESISTOR_0201  [0201]
R14189  10K  RESISTOR_0201  [0201]
R14190  10K  RESISTOR_0201  [0201]
R14191  10K  RESISTOR_0201  [0201]
R14192  10K  RESISTOR_0201  [0201]
R14193  10K  RESISTOR_0201  [0201]
R14194  10K  RESISTOR_0201  [0201]
R14195  10K  RESISTOR_0201  [0201]
R14196  10K  RESISTOR_0201  [0201]
R14197  10K  RESISTOR_0201  [0201]
R14198  10K  RESISTOR_0201  [0201]
R14199  10K  RESISTOR_0201  [0201]
R14200  10K  RESISTOR_0201  [0201]
R14201  10K  RESISTOR_0201  [0201]
R14202  10K  RESISTOR_0201  [0201]
R14203  10K  RESISTOR_0201  [0201]
R14204  10K  RESISTOR_0201  [0201]
R14205  10K  RESISTOR_0201  [0201]
R14206  10K  RESISTOR_0201  [0201]
R14207  10K  RESISTOR_0201  [0201]
R14208  10K  RESISTOR_0201  [0201]
R14209  10K  RESISTOR_0201  [0201]
R14210  10K  RESISTOR_0201  [0201]
R14211  10K  RESISTOR_0201  [0201]
R14212  10K  RESISTOR_0201  [0201]
R14213  10K  RESISTOR_0201  [0201]
R14214  10K  RESISTOR_0201  [0201]
R14215  10K  RESISTOR_0201  [0201]
R14216  10K  RESISTOR_0201  [0201]
R14217  10K  RESISTOR_0201  [0201]
R14218  10K  RESISTOR_0201  [0201]
R14219  10K  RESISTOR_0201  [0201]
R14220  10K  RESISTOR_0201  [0201]
R14221  10K  RESISTOR_0201  [0201]
R14222  10K  RESISTOR_0201  [0201]
R14223  10K  RESISTOR_0201  [0201]
R14224  10K  RESISTOR_0201  [0201]
R14225  10K  RESISTOR_0201  [0201]
R14226  10K  RESISTOR_0201  [0201]
R14227  10K  RESISTOR_0201  [0201]
R14228  10K  RESISTOR_0201  [0201]
R14229  10K  RESISTOR_0201  [0201]
R14230  10K  RESISTOR_0201  [0201]
R14231  10K  RESISTOR_0201  [0201]
R14232  10K  RESISTOR_0201  [0201]
R14233  10K  RESISTOR_0201  [0201]
R14234  10K  RESISTOR_0201  [0201]
R14235  10K  RESISTOR_0201  [0201]
R14236  10K  RESISTOR_0201  [0201]
R14237  10K  RESISTOR_0201  [0201]
R14238  10K  RESISTOR_0201  [0201]
R14239  10K  RESISTOR_0201  [0201]
R14240  10K  RESISTOR_0201  [0201]
R14241  10K  RESISTOR_0201  [0201]
R14242  10K  RESISTOR_0201  [0201]
R14243  10K  RESISTOR_0201  [0201]
R14244  10K  RESISTOR_0201  [0201]
R14245  10K  RESISTOR_0201  [0201]
R14246  10K  RESISTOR_0201  [0201]
R14247  10K  RESISTOR_0201  [0201]
R14248  10K  RESISTOR_0201  [0201]
R14249  10K  RESISTOR_0201  [0201]
R14250  10K  RESISTOR_0201  [0201]
R14251  10K  RESISTOR_0201  [0201]
R14252  10K  RESISTOR_0201  [0201]
R14253  10K  RESISTOR_0201  [0201]
R14254  10K  RESISTOR_0201  [0201]
R14255  10K  RESISTOR_0201  [0201]
R14256  10K  RESISTOR_0201  [0201]
R14257  10K  RESISTOR_0201  [0201]
R14258  10K  RESISTOR_0201  [0201]
R14259  10K  RESISTOR_0201  [0201]
R14260  10K  RESISTOR_0201  [0201]
R14261  10K  RESISTOR_0201  [0201]
R14262  10K  RESISTOR_0201  [0201]
R14263  10K  RESISTOR_0201  [0201]
R14264  10K  RESISTOR_0201  [0201]
R14265  10K  RESISTOR_0201  [0201]
R14266  10K  RESISTOR_0201  [0201]
R14267  10K  RESISTOR_0201  [0201]
R14268  10K  RESISTOR_0201  [0201]
R14269  10K  RESISTOR_0201  [0201]
R14270  10K  RESISTOR_0201  [0201]
R14271  10K  RESISTOR_0201  [0201]
R14272  10K  RESISTOR_0201  [0201]
R14273  10K  RESISTOR_0201  [0201]
R14274  10K  RESISTOR_0201  [0201]
R14275  10K  RESISTOR_0201  [0201]
R14276  10K  RESISTOR_0201  [0201]
R14277  10K  RESISTOR_0201  [0201]
R14278  10K  RESISTOR_0201  [0201]
R14279  10K  RESISTOR_0201  [0201]
R14280  10K  RESISTOR_0201  [0201]
R14281  10K  RESISTOR_0201  [0201]
R14282  10K  RESISTOR_0201  [0201]
R14283  10K  RESISTOR_0201  [0201]
R14284  10K  RESISTOR_0201  [0201]
R14285  10K  RESISTOR_0201  [0201]
R14286  10K  RESISTOR_0201  [0201]
R14287  10K  RESISTOR_0201  [0201]
R14288  10K  RESISTOR_0201  [0201]
R14289  10K  RESISTOR_0201  [0201]
R14290  10K  RESISTOR_0201  [0201]
R14291  10K  RESISTOR_0201  [0201]
R14292  10K  RESISTOR_0201  [0201]
R14293  10K  RESISTOR_0201  [0201]
R14294  10K  RESISTOR_0201  [0201]
R14295  10K  RESISTOR_0201  [0201]
R14296  10K  RESISTOR_0201  [0201]
R14297  10K  RESISTOR_0201  [0201]
R14298  10K  RESISTOR_0201  [0201]
R14299  10K  RESISTOR_0201  [0201]
R14300  10K  RESISTOR_0201  [0201]
R14301  10K  RESISTOR_0201  [0201]
R14302  10K  RESISTOR_0201  [0201]
R14303  10K  RESISTOR_0201  [0201]
R14304  10K  RESISTOR_0201  [0201]
R14305  10K  RESISTOR_0201  [0201]
R14306  10K  RESISTOR_0201  [0201]
R14307  10K  RESISTOR_0201  [0201]
R14308  10K  RESISTOR_0201  [0201]
R14309  10K  RESISTOR_0201  [0201]
R14310  10K  RESISTOR_0201  [0201]
R14311  10K  RESISTOR_0201  [0201]
R14312  10K  RESISTOR_0201  [0201]
R14313  10K  RESISTOR_0201  [0201]
R14314  10K  RESISTOR_0201  [0201]
R14315  10K  RESISTOR_0201  [0201]
R14316  10K  RESISTOR_0201  [0201]
R14317  10K  RESISTOR_0201  [0201]
R14318  10K  RESISTOR_0201  [0201]
R14319  10K  RESISTOR_0201  [0201]
R14320  10K  RESISTOR_0201  [0201]
R14321  10K  RESISTOR_0201  [0201]
R14322  10K  RESISTOR_0201  [0201]
R14323  10K  RESISTOR_0201  [0201]
R14324  10K  RESISTOR_0201  [0201]
R14325  10K  RESISTOR_0201  [0201]
R14326  10K  RESISTOR_0201  [0201]
R14327  10K  RESISTOR_0201  [0201]
R14328  10K  RESISTOR_0201  [0201]
R14329  10K  RESISTOR_0201  [0201]
R14330  10K  RESISTOR_0201  [0201]
R14331  10K  RESISTOR_0201  [0201]
R14332  10K  RESISTOR_0201  [0201]
R14333  10K  RESISTOR_0201  [0201]
R14334  10K  RESISTOR_0201  [0201]
R14335  10K  RESISTOR_0201  [0201]
R14336  10K  RESISTOR_0201  [0201]
R14337  10K  RESISTOR_0201  [0201]
R14338  10K  RESISTOR_0201  [0201]
R14339  10K  RESISTOR_0201  [0201]
R14340  10K  RESISTOR_0201  [0201]
R14341  10K  RESISTOR_0201  [0201]
R14342  10K  RESISTOR_0201  [0201]
R14343  10K  RESISTOR_0201  [0201]
R14344  10K  RESISTOR_0201  [0201]
R14345  10K  RESISTOR_0201  [0201]
R14346  10K  RESISTOR_0201  [0201]
R14347  10K  RESISTOR_0201  [0201]
R14348  10K  RESISTOR_0201  [0201]
R14349  10K  RESISTOR_0201  [0201]
R14350  10K  RESISTOR_0201  [0201]
R14351  10K  RESISTOR_0201  [0201]
R14352  10K  RESISTOR_0201  [0201]
R14353  10K  RESISTOR_0201  [0201]
R14354  10K  RESISTOR_0201  [0201]
R14355  10K  RESISTOR_0201  [0201]
R14356  10K  RESISTOR_0201  [0201]
R14357  10K  RESISTOR_0201  [0201]
R14358  10K  RESISTOR_0201  [0201]
R14359  10K  RESISTOR_0201  [0201]
R14360  10K  RESISTOR_0201  [0201]
R14361  10K  RESISTOR_0201  [0201]
R14362  10K  RESISTOR_0201  [0201]
R14363  10K  RESISTOR_0201  [0201]
R14364  10K  RESISTOR_0201  [0201]
R14365  10K  RESISTOR_0201  [0201]
R14366  10K  RESISTOR_0201  [0201]
R14367  10K  RESISTOR_0201  [0201]
R14368  10K  RESISTOR_0201  [0201]
R14369  10K  RESISTOR_0201  [0201]
R14370  10K  RESISTOR_0201  [0201]
R14371  10K  RESISTOR_0201  [0201]
R14372  10K  RESISTOR_0201  [0201]
R14373  10K  RESISTOR_0201  [0201]
R14374  10K  RESISTOR_0201  [0201]
R14375  10K  RESISTOR_0201  [0201]
R14376  10K  RESISTOR_0201  [0201]
R14377  10K  RESISTOR_0201  [0201]
R14378  10K  RESISTOR_0201  [0201]
R14379  10K  RESISTOR_0201  [0201]
R14380  10K  RESISTOR_0201  [0201]
R14381  10K  RESISTOR_0201  [0201]
R14382  10K  RESISTOR_0201  [0201]
R14383  10K  RESISTOR_0201  [0201]
R14384  10K  RESISTOR_0201  [0201]
R14385  10K  RESISTOR_0201  [0201]
R14386  10K  RESISTOR_0201  [0201]
R14387  10K  RESISTOR_0201  [0201]
R14388  10K  RESISTOR_0201  [0201]
R14389  10K  RESISTOR_0201  [0201]
R14390  10K  RESISTOR_0201  [0201]
R14391  10K  RESISTOR_0201  [0201]
R14392  10K  RESISTOR_0201  [0201]
R14393  10K  RESISTOR_0201  [0201]
R14394  10K  RESISTOR_0201  [0201]
R14395  10K  RESISTOR_0201  [0201]
R14396  10K  RESISTOR_0201  [0201]
R14397  10K  RESISTOR_0201  [0201]
R14398  10K  RESISTOR_0201  [0201]
R14399  10K  RESISTOR_0201  [0201]
R14400  10K  RESISTOR_0201  [0201]
R14401  10K  RESISTOR_0201  [0201]
R14402  10K  RESISTOR_0201  [0201]
R14403  10K  RESISTOR_0201  [0201]
R14404  10K  RESISTOR_0201  [0201]
R14405  10K  RESISTOR_0201  [0201]
R14406  10K  RESISTOR_0201  [0201]
R14407  10K  RESISTOR_0201  [0201]
R14408  10K  RESISTOR_0201  [0201]
R14409  10K  RESISTOR_0201  [0201]
R14410  10K  RESISTOR_0201  [0201]
R14411  10K  RESISTOR_0201  [0201]
R14412  10K  RESISTOR_0201  [0201]
R14413  10K  RESISTOR_0201  [0201]
R14414  10K  RESISTOR_0201  [0201]
R14415  10K  RESISTOR_0201  [0201]
R14416  10K  RESISTOR_0201  [0201]
R14417  10K  RESISTOR_0201  [0201]
R14418  10K  RESISTOR_0201  [0201]
R14419  10K  RESISTOR_0201  [0201]
R14420  10K  RESISTOR_0201  [0201]
R14421  10K  RESISTOR_0201  [0201]
R14422  10K  RESISTOR_0201  [0201]
R14423  10K  RESISTOR_0201  [0201]
R14424  10K  RESISTOR_0201  [0201]
R14425  10K  RESISTOR_0201  [0201]
R14426  10K  RESISTOR_0201  [0201]
R14427  10K  RESISTOR_0201  [0201]
R14428  10K  RESISTOR_0201  [0201]
R14429  10K  RESISTOR_0201  [0201]
R14430  10K  RESISTOR_0201  [0201]
R14431  10K  RESISTOR_0201  [0201]
R14432  10K  RESISTOR_0201  [0201]
R14433  10K  RESISTOR_0201  [0201]
R14434  10K  RESISTOR_0201  [0201]
R14435  10K  RESISTOR_0201  [0201]
R14436  10K  RESISTOR_0201  [0201]
R14437  10K  RESISTOR_0201  [0201]
R14438  10K  RESISTOR_0201  [0201]
R14439  10K  RESISTOR_0201  [0201]
R14440  10K  RESISTOR_0201  [0201]
R14441  10K  RESISTOR_0201  [0201]
R14442  10K  RESISTOR_0201  [0201]
R14443  10K  RESISTOR_0201  [0201]
R14444  10K  RESISTOR_0201  [0201]
R14445  10K  RESISTOR_0201  [0201]
R14446  10K  RESISTOR_0201  [0201]
R14447  10K  RESISTOR_0201  [0201]
R14448  10K  RESISTOR_0201  [0201]
R14449  10K  RESISTOR_0201  [0201]
R14450  10K  RESISTOR_0201  [0201]
R14451  10K  RESISTOR_0201  [0201]
R14452  10K  RESISTOR_0201  [0201]
R14453  10K  RESISTOR_0201  [0201]
R14454  10K  RESISTOR_0201  [0201]
R14455  10K  RESISTOR_0201  [0201]
R14456  10K  RESISTOR_0201  [0201]
R14457  10K  RESISTOR_0201  [0201]
R14458  10K  RESISTOR_0201  [0201]
R14459  10K  RESISTOR_0201  [0201]
R14460  10K  RESISTOR_0201  [0201]
R14461  10K  RESISTOR_0201  [0201]
R14462  10K  RESISTOR_0201  [0201]
R14463  10K  RESISTOR_0201  [0201]
R14464  10K  RESISTOR_0201  [0201]
R14465  10K  RESISTOR_0201  [0201]
R14466  10K  RESISTOR_0201  [0201]
R14467  10K  RESISTOR_0201  [0201]
R14468  10K  RESISTOR_0201  [0201]
R14469  10K  RESISTOR_0201  [0201]
R14470  10K  RESISTOR_0201  [0201]
R14471  10K  RESISTOR_0201  [0201]
R14472  10K  RESISTOR_0201  [0201]
R14473  10K  RESISTOR_0201  [0201]
R14474  10K  RESISTOR_0201  [0201]
R14475  10K  RESISTOR_0201  [0201]
R14476  10K  RESISTOR_0201  [0201]
R14477  10K  RESISTOR_0201  [0201]
R14478  10K  RESISTOR_0201  [0201]
R14479  10K  RESISTOR_0201  [0201]
R14480  10K  RESISTOR_0201  [0201]
R14481  10K  RESISTOR_0201  [0201]
R14482  10K  RESISTOR_0201  [0201]
R14483  10K  RESISTOR_0201  [0201]
R14484  10K  RESISTOR_0201  [0201]
R14485  10K  RESISTOR_0201  [0201]
R14486  10K  RESISTOR_0201  [0201]
R14487  10K  RESISTOR_0201  [0201]
R14488  10K  RESISTOR_0201  [0201]
R14489  10K  RESISTOR_0201  [0201]
R14490  10K  RESISTOR_0201  [0201]
R14491  10K  RESISTOR_0201  [0201]
R14492  10K  RESISTOR_0201  [0201]
R14493  10K  RESISTOR_0201  [0201]
R14494  10K  RESISTOR_0201  [0201]
R14495  10K  RESISTOR_0201  [0201]
R14496  10K  RESISTOR_0201  [0201]
R14497  10K  RESISTOR_0201  [0201]